# EasyEDA Pro project ProPrj_Avaota A1 八核 AIoT 开发板_2024-05-03.epro, schematic Avaota Pi A, sheets 6 to 13 of 13 (continued)
## Sheets (continued)
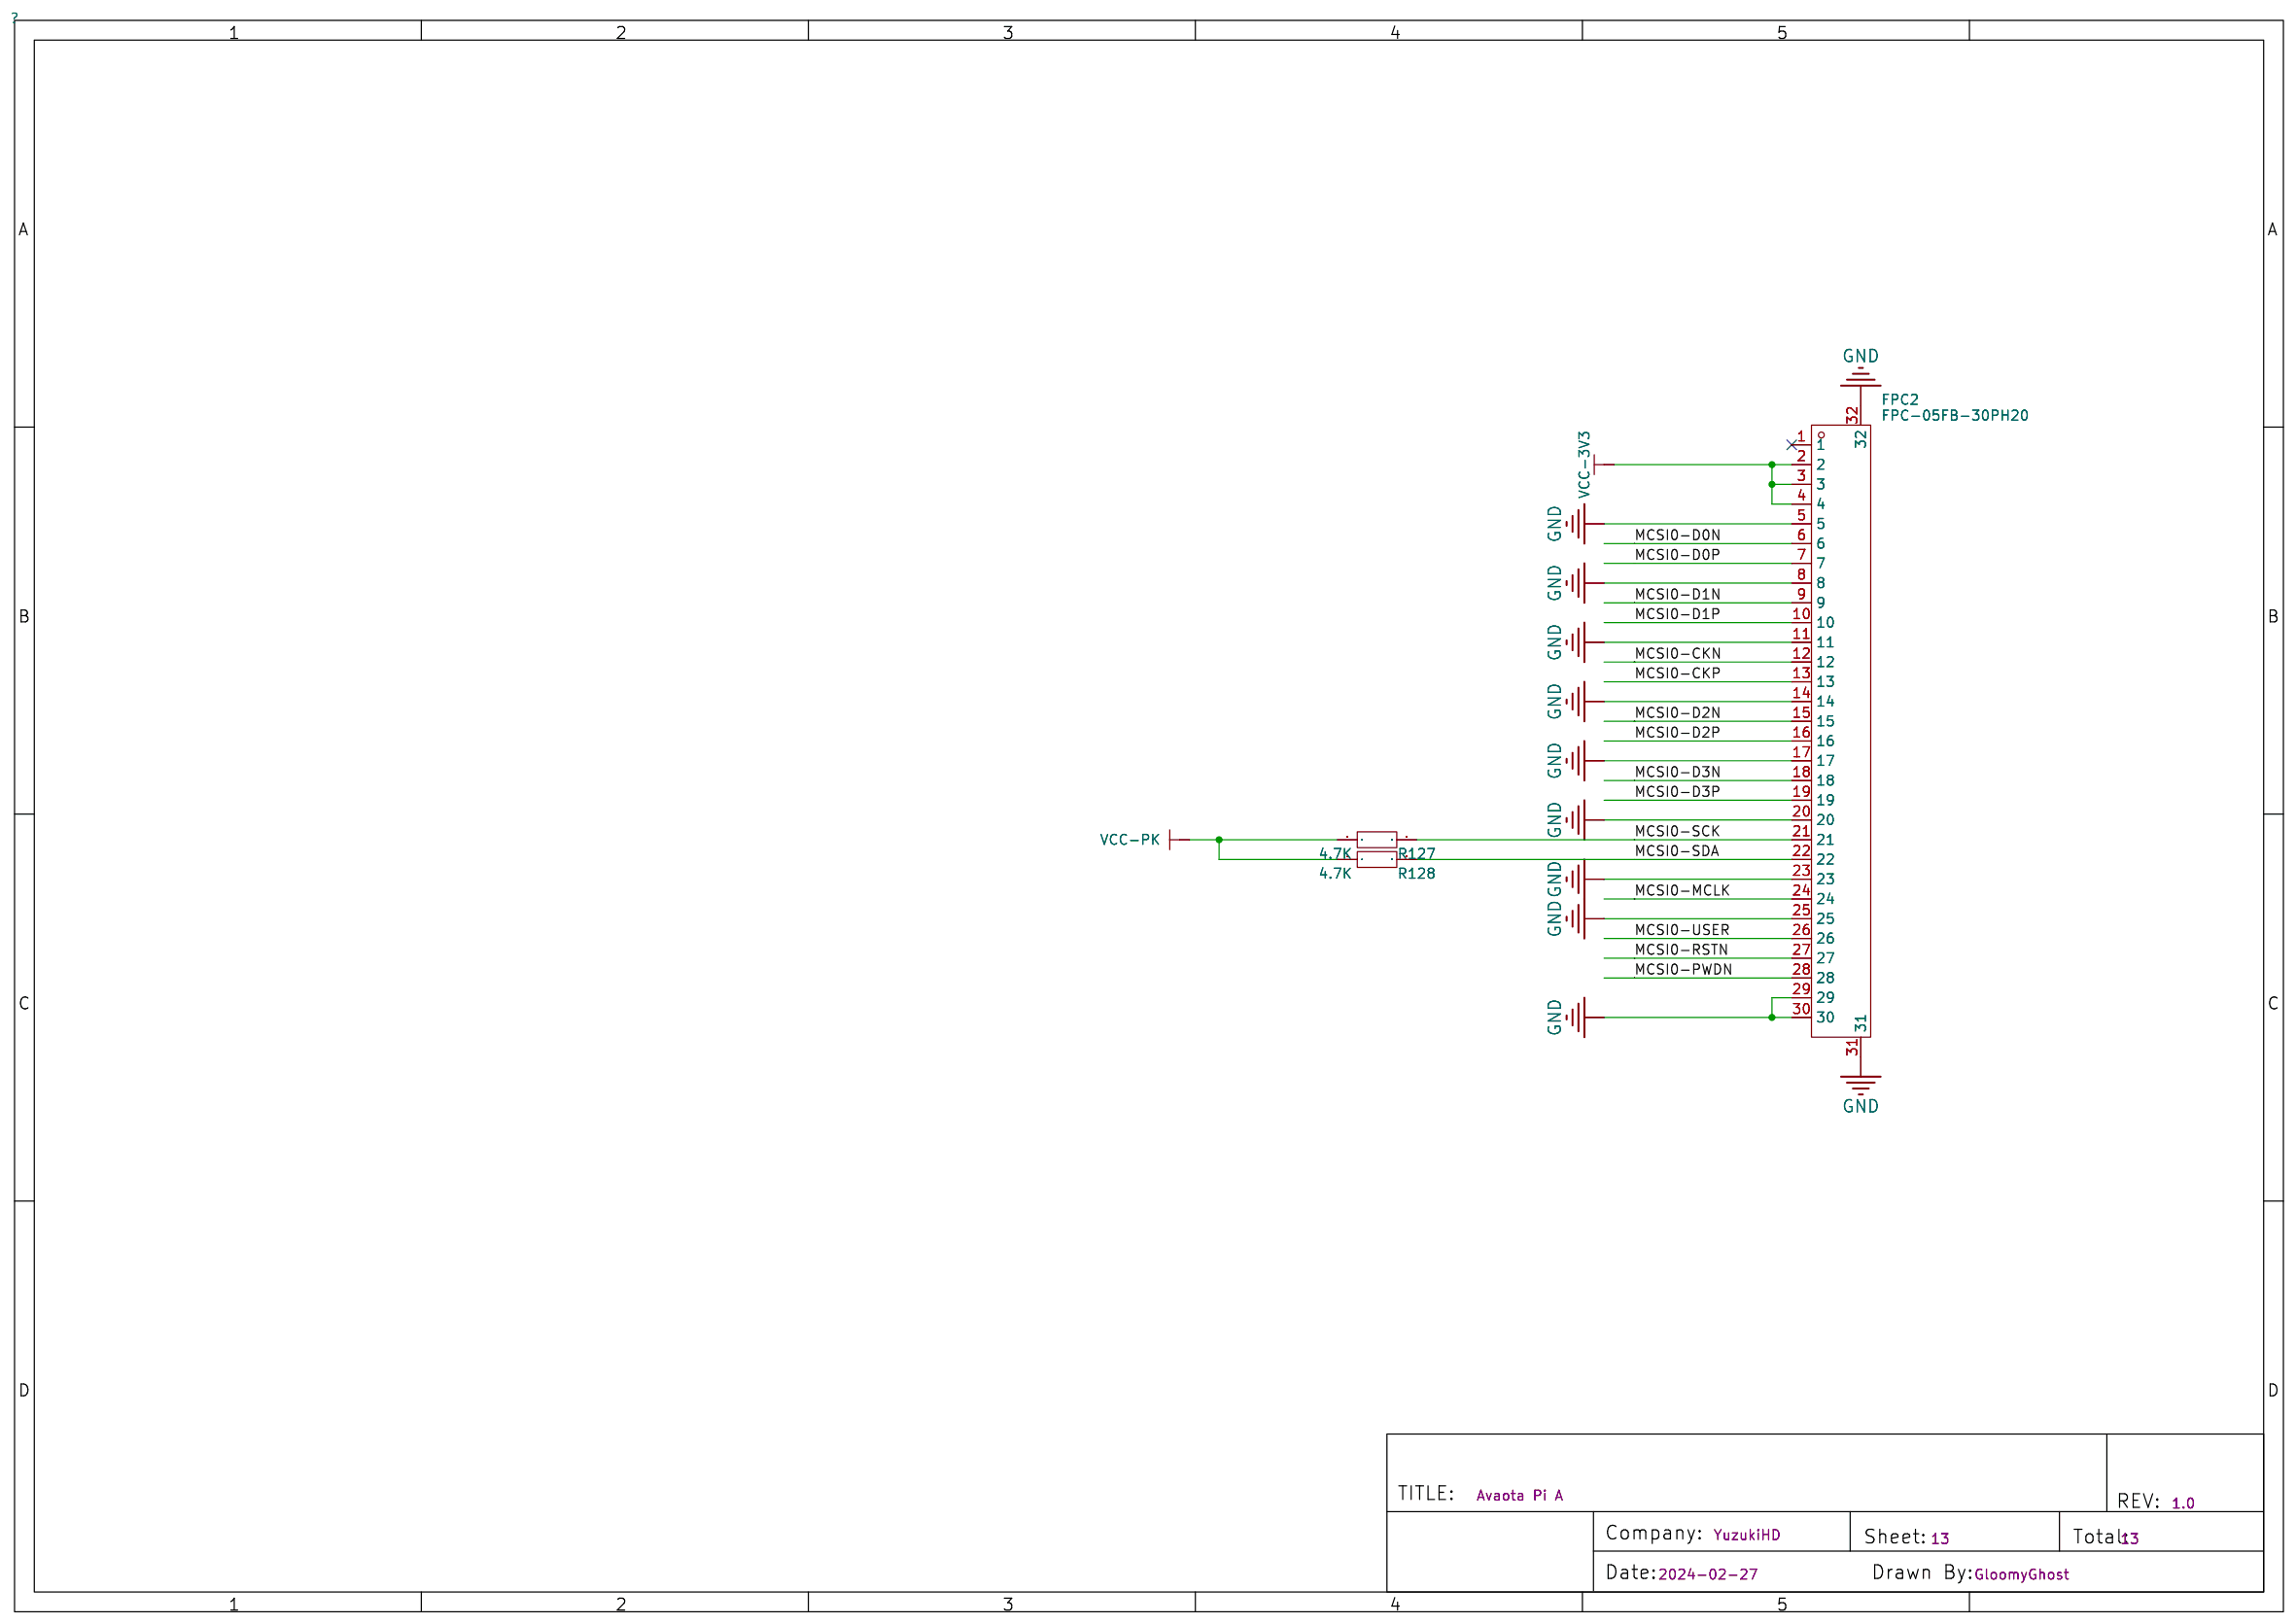
[diagram p12: CAMERA]

## Parts
sheet 12VDC
C1  100nF  [C0603-NSK]
C2  100nF  [C0603-NSK]
C3  100nF  [C0603-NSK]
C4  100nF  [c0402-nsk]
C5  47uF  [C0805 NSK]
C6  47uF  [C0805 NSK]
C7  100nF  [C0603-NSK]
C8  100nF  [C0603-NSK]
C9  2200pF  [c0402-nsk]
C10  22pF  [c0402-nsk]
CN4  0533980271  [CONN-SMD_2P-P1.25_053398-0X71]
D1  B5819WS  [SOD-323_L1.8-W1.3-LS2.5-RD]
D2  SMCJ15CA  [SMC_L6.9-W5.9-LS7.9-BI]
D3  SS54  [SMA_L4.4-W2.8-LS5.4-R-RD]
D4  SS54  [SMA_L4.4-W2.8-LS5.4-R-RD]
DC1  DC-044A-A200  [DC-IN-TH_DC-044A-20A]
L1  4.7uH  [IND-SMD_L7.0-W6.6]
Q1  YJL2305A  [SOT-23-3_L2.9-W1.3-P1.90-LS2.4-BR]
R1  100K  [R0603 NSK]
R2  100K  [R0603 NSK]
R3  51.1  [R0402-NSK]
R4  665K  [R0402-NSK]
R5  10.2K  [R0402-NSK]
R6  130K  [R0402-NSK]
R7  37.4K  [R0402-NSK]
R8  1.96K  [R0402-NSK]
U1  100uF  [CAP-SMD_BD6.3-L6.6-W6.6-LS7.6-RD]
U2  100uF  [CAP-SMD_BD6.3-L6.6-W6.6-LS7.6-RD]
U3  TPS54531DDAR  [SOIC-8_L5.0-W4.0-P1.27-LS6.0-BL-EP2.0]
sheet CAMERA
FPC2  FPC-05FB-30PH20  [FPC-SMD_30P-P0.50_FPC-05FB-30PH20]
R127  4.7K  [r0201 nsk]
R128  4.7K  [r0201 nsk]
sheet GMAC0
C248  10nF/2KV  [C1206]
C249  2.2uF  [c0201 nsk]
C250  2.2uF  [c0201 nsk]
C251  22pF  [c0201 nsk]
C252  22pF  [c0201 nsk]
C253  2.2uF  [c0201 nsk]
C254  100nF  [c0201 nsk]
C262  100nF  [c0201 nsk]
C263  100nF  [c0201 nsk]
C264  100nF  [c0201 nsk]
C265  100nF  [c0201 nsk]
C266  100nF  [c0201 nsk]
C267  100nF  [c0201 nsk]
C268  100nF  [c0201 nsk]
L9  2.2uH  [IND-SMD_L2.0-W1.6]
R79  510  [r0201 nsk]
R80  510  [r0201 nsk]
R82  4.7K  [r0201 nsk]
R83  1.5K  [r0201 nsk]
R85  2.49K  [r0201 nsk]
R86  4.7K  [r0201 nsk]
R88  4.7K  [r0201 nsk]
R89  4.7K  [r0201 nsk]
R90  4.7K  [r0201 nsk]
R91  4.7K  [r0201 nsk]
R92  4.7K  [r0201 nsk]
R93  4.7K  [r0201 nsk]
R94  4.7K  [r0201 nsk]
R95  4.7K  [r0201 nsk]
R96  4.7K  [r0201 nsk]
RJ1  -  [RJ45-TH_HR911130A]
U12  RTL8211F-CG  [WQFN-40_L5.0-W5.0-P0.4-BL-EP]
X3  25MHz  [crystal-smd_4p-l2.0-w1.6-bl-nsk]
sheet GMAC1
C255  10nF/2KV  [C1206]
C256  2.2uF  [c0201 nsk]
C257  22pF  [c0201 nsk]
C258  2.2uF  [c0201 nsk]
C259  22pF  [c0201 nsk]
C260  2.2uF  [c0201 nsk]
C261  100nF  [c0201 nsk]
C269  100nF  [c0201 nsk]
C270  100nF  [c0201 nsk]
C271  100nF  [c0201 nsk]
C272  100nF  [c0201 nsk]
C273  100nF  [c0201 nsk]
C274  100nF  [c0201 nsk]
C275  100nF  [c0201 nsk]
L10  2.2uH  [IND-SMD_L2.0-W1.6]
R97  510  [r0201 nsk]
R98  510  [r0201 nsk]
R100  4.7K  [r0201 nsk]
R101  1.5K  [r0201 nsk]
R103  2.49K  [r0201 nsk]
R104  4.7K  [r0201 nsk]
R106  4.7K  [r0201 nsk]
R107  4.7K  [r0201 nsk]
R108  4.7K  [r0201 nsk]
R109  4.7K  [r0201 nsk]
R110  4.7K  [r0201 nsk]
R111  4.7K  [r0201 nsk]
R112  4.7K  [r0201 nsk]
R113  4.7K  [r0201 nsk]
R114  4.7K  [r0201 nsk]
RJ2  -  [RJ45-TH_HR911130A]
U13  RTL8211F-CG  [WQFN-40_L5.0-W5.0-P0.4-BL-EP]
X4  25MHz  [crystal-smd_4p-l2.0-w1.6-bl-nsk]
sheet PERF1
C189  100nF  [c0201 nsk]
C190  100nF  [c0201 nsk]
C191  100nF  [c0201 nsk]
C192  100nF  [c0201 nsk]
C193  100nF  [c0201 nsk]
C194  100nF  [c0201 nsk]
C195  100nF  [c0201 nsk]
C196  100nF  [c0201 nsk]
C197  100nF  [c0201 nsk]
C198  100nF  [c0201 nsk]
C199  100nF  [c0201 nsk]
C200  10uF  [c0402-nsk]
C201  2.2uF  [c0201 nsk]
C202  2.2uF  [c0201 nsk]
C204  2.2uF  [c0201 nsk]
C208  2.2uF  [c0201 nsk]
C209  100nF  [c0201 nsk]
C210  2.2uF  [c0201 nsk]
C211  100nF  [c0201 nsk]
C213  100nF  [c0201 nsk]
C214  2.2uF  [c0201 nsk]
C215  2.2uF  [c0201 nsk]
C216  100nF  [c0201 nsk]
C218  100nF  [c0201 nsk]
C219  100nF  [c0201 nsk]
C220  100nF  [c0201 nsk]
C221  2.2uF  [c0402-nsk]
C222  100nF  [c0402-nsk]
C223  2.2uF  [c0402-nsk]
C224  100nF  [c0402-nsk]
C280  100nF  [c0402-nsk]
C281  22uF  [C0603-NSK]
C282  22uF  [C0603-NSK]
C294  22uF  [C1206]
D5  RClamp0524PATCT  [SLP2510P8_L2.5-W1.0-P0.50-BL]
D6  RClamp0524PATCT  [SLP2510P8_L2.5-W1.0-P0.50-BL]
D7  B5819WT  [SOD-523_L1.2-W0.8-LS1.6-RD-1 NSK]
D8  RClamp0524PATCT  [SLP2510P8_L2.5-W1.0-P0.50-BL]
D9  B5819WT  [SOD-523_L1.2-W0.8-LS1.6-RD-1 NSK]
D10  RClamp0524PATCT  [SLP2510P8_L2.5-W1.0-P0.50-BL]
D11  RClamp0524PATCT  [SLP2510P8_L2.5-W1.0-P0.50-BL]
D12  RClamp0524PATCT  [SLP2510P8_L2.5-W1.0-P0.50-BL]
D13  RClamp0524PATCT  [SLP2510P8_L2.5-W1.0-P0.50-BL]
D14  RClamp0524PATCT  [SLP2510P8_L2.5-W1.0-P0.50-BL]
D15  RClamp0524PATCT  [SLP2510P8_L2.5-W1.0-P0.50-BL]
D24  0402ESDA-05N  [d0402]
D25  0402ESDA-05N  [d0402]
D26  0402ESDA-05N  [d0402]
D27  0402ESDA-05N  [d0402]
D30  0402ESDA-05N  [d0402]
D31  0402ESDA-05N  [d0402]
R44  200  [r0201 nsk]
R45  200  [r0201 nsk]
R46  200  [r0201 nsk]
R47  10K  [r0201 nsk]
R48  100  [r0201 nsk]
R49  1K  [r0201 nsk]
R50  100  [r0201 nsk]
R51  100  [r0201 nsk]
R52  4K7  [r0201 nsk]
R53  4K7  [r0201 nsk]
R54  1K  [r0201 nsk]
R55  1K  [r0201 nsk]
R56  1M  [r0201 nsk]
R57  1M  [r0201 nsk]
R59  1K  [r0201 nsk]
R60  10K  [r0201 nsk]
R61  100K  [r0201 nsk]
R62  100K  [r0201 nsk]
R117  6K8  [r0201 nsk]
R118  100K  [r0201 nsk]
R120  180K  [r0201 nsk]
R121  100K  [r0201 nsk]
R129  5.1K  [r0201 nsk]
R130  5.1K  [r0201 nsk]
U15  -  [DP_TH_SIDE_VERTICAL]
U17  SY6280AAC  [SOT-23-5_L3.0-W1.7-P0.95-LS2.8-BL]
USB1  HDMI-001C  [HDMI-SMD_HDMI-001C]
USB2  USB-303WSD-BRY  [USB-A-TH_XUNPU_USB-303WSD-BRY]
USB3  -  [USB-C-SMD_TYPEC-304-BCP16-1]
sheet PERF2
C225  2.2uF  [c0201 nsk]
C226  100nF  [c0201 nsk]
C227  100nF  [c0201 nsk]
C228  2.2uF  [c0201 nsk]
C229  100nF  [c0201 nsk]
C230  100nF  [c0201 nsk]
C231  2.2uF  [c0201 nsk]
C232  100nF  [c0201 nsk]
C233  100nF  [c0201 nsk]
C234  2.2uF  [c0201 nsk]
C235  100nF  [c0201 nsk]
C236  100nF  [c0201 nsk]
C276  2.2uF  [c0201 nsk]
C277  2.2uF  [c0201 nsk]
D16  0402ESDA-05N  [D0402]
D17  0402ESDA-05N  [D0402]
D18  0402ESDA-05N  [D0402]
D19  0402ESDA-05N  [D0402]
D20  0402ESDA-05N  [D0402]
D21  0402ESDA-05N  [D0402]
D22  0402ESDA-05N  [D0402]
D23  0402ESDA-05N  [D0402]
FPC1  FPC-05FB-50PH20  [FPC-SMD_50P-P0.50_FPC-05FB-50PH20]
H1  12251220ANG0S115001  [HDR-TH_40P-P2.54-V-M-R2-C20-S2.54]
LED2  WS2812B-2020  [LED-SMD_4P-L2.0-W2.0-TL_WS2812B-2020]
LED3  WS2812B-2020  [LED-SMD_4P-L2.0-W2.0-TL_WS2812B-2020]
LED4  WS2812B-2020  [LED-SMD_4P-L2.0-W2.0-TL_WS2812B-2020]
LED5  WS2812B-2020  [LED-SMD_4P-L2.0-W2.0-TL_WS2812B-2020]
R63  10K  [r0201 nsk]
R115  6K8  [r0201 nsk]
R116  6K8  [r0201 nsk]
R119  100K  [r0201 nsk]
R126  1K  [R0402-NSK]
SIM1  1040310811  [SIM-SMD_8P-1040310811]
TFT1  -  [TFT_1.14寸_0.7MM-13P]
U8  -  [FBGA-153_L13.0-W11.5]
U16  SY6280AAC  [SOT-23-5_L3.0-W1.7-P0.95-LS2.8-BL]
sheet PERF3
C237  2.2uF  [c0402-nsk]
C238  100nF  [c0201 nsk]
C239  33pF  [c0201 nsk]
C240  100nF  [c0201 nsk]
C241  100nF  [c0201 nsk]
C242  100nF  [c0402-nsk]
C243  100nF  [c0402-nsk]
C244  NC  [c0201 nsk]
C245  NC  [c0201 nsk]
C246  100nF  [c0402-nsk]
C247  2.2uF  [c0402-nsk]
CGQ1  IRM-H638T/TR2  [SENSOR-SMD_IRM-H638T-TR2-TL]
CN2  PJ-327A0-SMT  [AUDIO-SMD_PJ-327A0-SMT]
CN3  0533980271  [CONN-SMD_2P-P1.25_053398-0X71]
R64  2K  [r0201 nsk]
R65  10K  [r0201 nsk]
R66  10K  [r0201 nsk]
R67  22  [r0201 nsk]
R68  22  [r0201 nsk]
R69  10K  [r0201 nsk]
R70  10K  [r0201 nsk]
R72  0  [r0201 nsk]
R73  10K  [r0201 nsk]
R74  10K  [r0201 nsk]
R75  10K  [r0201 nsk]
R76  10K  [r0201 nsk]
R77  60  [r0201 nsk]
R78  60  [r0201 nsk]
R122  0  [r0201 nsk]
R124  10k  [r0201 nsk]
R125  33  [r0201 nsk]
RF1  BWIPX-1-001E  [IPEX-SMD_BWIPX-1-001E]
U9  AIC8800D  [LGA-44_L12.0-W12.0-P0.90]
U11  TJA1051T  [SOP-8_L4.9-W3.9-P1.27-LS6.0-BL]
U18  W25N01GVZEIG  [WSON-8_L8.0-W6.10-P1.27-BL-EP]
sheet POWER
U14  T527  [T527-BGA664]  (sections Audio_ADC,DRAM,GND,IO_1,IO_2,PERF,SoC,VCC)

## Library data of the parts
C1-C3 C7 C8 C281 C282 = CAP_0603: Supplier Footprint: 0603
C4 C9 C10 C200 C221-C224 C237 C242 C243 C246 C247 C280 = CAP_0402: Supplier Footprint: 0402
C5 C6 = CAP_0805: Supplier Footprint: 0805
CN3 CN4 = 0533980271: 插针结构:1x2P;间距:1.25mm;安装方式:立贴;参考系列:-;总PIN数:2P;排数:1;每排PIN数:2;行距:-;额定电流:-;触头材质:磷青铜;触头镀层:锡;工作温度范围:-;; LCSC Part Name: 1x2P 间距:1.25mm 立贴; Supplier Part: C122410; Manufacturer: MOLEX; Supplier Footprint: SMD,P=1.25mm; JLCPCB Part Class: 扩展库; Datasheet: https://atta.szlcsc.com/upload/public/pdf/source/20170721/C122410_1500619309943834053.pdf; Supplier: LCSC; Pins Structure: 1x2P; Pitch: 1.25mm; Mounting Style: 立贴; Number of Pins: 2P; Number of Rows: 1; Number of PINs Per Row: 2; Contact Material: 磷青铜; Contact Plating: 锡
D1 = B5819WS_C22624: 正向压降(Vf):600mV@1A;直流反向耐压(Vr):40V;平均整流电流(Io):1A;; LCSC Part Name: 电压:40V 电流:1A; Supplier Part: C22624; Manufacturer: CJ(江苏长电/长晶); Supplier Footprint: SOD-323; JLCPCB Part Class: 扩展库; Datasheet: https://atta.szlcsc.com/upload/public/pdf/source/20150407/1457707273359.pdf; Supplier: LCSC; Forward Voltage (Vf@If): 600mV@1A; Reverse Voltage (Vr): 40V; Average Rectified Current (Io): 1A
D2 = SMCJ15CA_C438202: Supplier Part: C438202; Manufacturer: 晶导微电子; Supplier Footprint: SMC; JLCPCB Part Class: 扩展库; Datasheet: https://atta.szlcsc.com/upload/public/pdf/source/20191016/C438242_A63B17745ADA505032D55B9AC6D6140F.pdf; Supplier: LCSC
D3 D4 = SS54_C22452: 正向压降(Vf):550mV@5A;直流反向耐压(Vr):40V;平均整流电流(Io):5A;; LCSC Part Name: 电压:40V 电流:5A; Supplier Part: C22452; Manufacturer: MDD; Supplier Footprint: SMA(DO-214AC); JLCPCB Part Class: 基础库; Datasheet: https://atta.szlcsc.com/upload/public/pdf/source/20230314/529CD85F9B31F69841D3A079BC07E377.pdf; Supplier: LCSC; Forward Voltage (Vf@If): 550mV@5A; Reverse Voltage (Vr): 40V; Average Rectified Current (Io): 5A; Reverse Leakage Current (Ir): 1mA@40V
DC1 = DC-044A-A200: 连接器类型:DC电源插座;安装方式:弯插;触点内径:2mm;触点外径:5.9mm;额定电流:3A;额定电压:30V;工作温度范围:-20℃~+70℃;; LCSC Part Name: DC电源插座 内径:2mm 外径:5.9mm; Supplier Part: C720575; Manufacturer: XUNPU(讯普); Supplier Footprint: 插件; JLCPCB Part Class: 扩展库; Datasheet: https://atta.szlcsc.com/upload/public/pdf/source/20200812/C720575_4790492998F066C820F633EA8FAFF763.pdf; Supplier: LCSC; Connector Type: DC电源插座; Mounting Style: 弯插; Inside Contact Diameter: 2mm; Outside Contact Diameter: 5.9mm; Current Rating (Max): 3A; Voltage Rating (Max): 30V; Operating Temperature Range: -20℃~+70℃
L1 = FXL0630-4R7-M: 电感值:4.7uH;精度:±20%;额定电流:6A;饱和电流(Isat):9A;类型:一体成型电感;; LCSC Part Name: 4.7uH ±20% 9A; Supplier Part: C167220; Manufacturer: cjiang(长江微电); Supplier Footprint: SMD,6.6x7mm; JLCPCB Part Class: 扩展库; Datasheet: https://atta.szlcsc.com/upload/public/pdf/source/20230516/3A080F5AF8C87BB81C3BA86E5F60E51A.pdf; Supplier: LCSC; Tolerance: ±20%; Rated Current: 6A; Saturation Current (Isat): 9A; DC Resistance (DCR): 33mΩ; Type: 一体成型电感
Q1 = YJL2305A: 类型:P沟道;漏源电压(Vdss):15V;连续漏极电流(Id):5.6A;功率(Pd):1.2W;导通电阻(RDS(on)@Vgs,Id):25mΩ@4.5V,5.6A;阈值电压(Vgs(th)@Id):1V@250uA;; LCSC Part Name: P沟道 耐压:15V 电流:5.6A; Supplier Part: C699306; Manufacturer: YANGJIE(扬杰); Supplier Footprint: SOT-23(TO-236); JLCPCB Part Class: 扩展库; Datasheet: https://atta.szlcsc.com/upload/public/pdf/source/20200709/C699306_A321381AA1EB3D502A51672BD4542002.pdf; Supplier: LCSC; Type: P沟道; Drain Source Voltage (Vdss): 15V; Continuous Drain Current (Id): 5.6A; Power Dissipation (Pd): 1.2W; Drain Source On Resistance (RDS(on)@Vgs,Id): 25mΩ@4.5V,5.6A; Gate Threshold Voltage (Vgs(th)@Id): 1V@250uA; Total Gate Charge (Qg@Vgs): 7.2nC@4.5V; Input Capacitance (Ciss@Vds): 890pF@9V; Reverse Transfer Capacitance (Crss@Vds): 85pF@9V; Operating Temperature: -55℃~+150℃@(Tj)
R1 R2 = Res_0603: Supplier Footprint: 0603
R3-R8 R126 = Res_0402: Supplier Footprint: 0402
U1 U2 = RVT1H101M0607: 容值:100uF;精度:±20%;额定电压:50V;纹波电流:229mA@120Hz;; LCSC Part Name: 100uF ±20% 50V; Supplier Part: C3151829; Manufacturer: ROQANG(容强); Supplier Footprint: SMD,D6.3xL7.7mm; JLCPCB Part Class: 扩展库; Datasheet: https://atta.szlcsc.com/upload/public/pdf/source/20170325/1490427950282.pdf; Supplier: LCSC; Tolerance: ±20%; Rated Voltage: 50V; Ripple Current: 229mA@120Hz; φD: 6.3mm; L: 7.7mm; Lifetime @ Temp: 2000hrs@105℃; Operating Temperature: -40℃~+105℃
U3 = TPS54531DDAR: 功能类型:降压型;输出类型:可调;输入电压:3.5V~28V;输出电压:800mV~26.04V;输出电流(最大值):5A;; Supplier Part: C50605; Manufacturer: TI(德州仪器); Supplier Footprint: SOIC-8-EP; JLCPCB Part Class: 扩展库; Datasheet: https://www.ti.com/cn/lit/gpn/tps54531; Supplier: LCSC; Function: 降压型; Output Type: 可调; Input Voltage: 3.5V~28V; Output Voltage: 800mV~26.04V; Output Current (Max): 5A; Switching Frequency: 570kHz; Operating Temperature: -40℃~+85℃@(TA); Synchronous Rectification: 否; Number of Outputs: 1; Topology: 降压式; Switch tube (built-in/external): 内置
FPC2 = FPC-05FB-30PH20: 锁定特性:翻盖式;触点类型:双侧触点/上下接;触点数量:30P;间距:0.5mm;安装类型:卧贴;工作温度范围:-25℃~+85℃;; LCSC Part Name: 间距:0.5mm P数:30P 翻盖式 双侧触点/上下接; Supplier Part: C2856833; Manufacturer: XUNPU(讯普); Supplier Footprint: SMD,P=0.5mm,卧贴; JLCPCB Part Class: 扩展库; Datasheet: https://atta.szlcsc.com/upload/public/pdf/source/20210922/C2856833_974F2E309F01E02BEE862D1FB45F93FA.pdf; Supplier: LCSC; Locking Feature: 翻盖式; Contact Type: 双侧触点/上下接; Number of Contacts: 30P; Pitch: 0.5mm; Mounting Type: 卧贴; FFC, FCB Thickness: 0.3mm; Height Above Board: 2mm; Operating Temperature Range: -25℃~+85℃
R44-R57 R59-R70 R72-R80 R82 R83 R85 R86 R88-R98 R100 R101 R103 R104 R106-R122 R124 R125 R127-R130 = Res_0201: Supplier Footprint: 0201
C248 C255 C294 = CAP_1206: Supplier Footprint: 1206
C225 C228 C231 C234 C249 C250 C253 C254 C256 C258 C260-C277 = 0201X225M6R3NT: 容值:2.2uF;精度:±20%;额定电压:6.3V;材质(温度系数):X5R;; LCSC Part Name: 2.2uF ±20% 6.3V; Supplier Part: C285111; Manufacturer: FH(风华); Supplier Footprint: 0201; JLCPCB Part Class: 扩展库; Datasheet: https://atta.szlcsc.com/upload/public/pdf/source/20180913/C285111_405173511BA094D64E8CAA96F7E40A73.pdf; Supplier: LCSC; Tolerance: ±20%; Voltage Rated: 6.3V; Temperature Coefficient: X5R
C251 C252 C257 C259 = 0201CG220J500NT: 容值:22pF;精度:±5%;额定电压:50V;材质(温度系数):C0G;; LCSC Part Name: 22pF ±5% 50V; Supplier Part: C57783; Manufacturer: FH(风华); Supplier Footprint: 0201; JLCPCB Part Class: 扩展库; Datasheet: https://atta.szlcsc.com/upload/public/pdf/source/20200305/C486355_26A10D38EF8C2A5C37091D0039909270.pdf; Supplier: LCSC; Tolerance: ±5%; Voltage Rated: 50V; Temperature Coefficient: C0G
L9 L10 = WPN252012H2R2MT: 电感值:2.2uH;精度:±20%;额定电流:1.9A;饱和电流(Isat):3A;类型:-;; LCSC Part Name: 2.2uH ±20% 3A; Supplier Part: C98350; Manufacturer: Sunlord(顺络); Supplier Footprint: 1008; JLCPCB Part Class: 扩展库; Datasheet: https://atta.szlcsc.com/upload/public/pdf/source/20231024/AA72387348CB63159A6CBE41DDE5ECDA.pdf; Supplier: LCSC; Tolerance: ±20%; Rated Current: 1.9A; Saturation Current (Isat): 3A; DC Resistance (DCR): 120mΩ
RJ1 RJ2 = HR911130A: 连接器类型:RJ插座;USOC代码:RJ45;端口数量:1;等级:-;屏蔽:-;LED:有;; LCSC Part Name: RJ45; Supplier Part: C54408; Manufacturer: HANRUN(汉仁); Supplier Footprint: 插件; JLCPCB Part Class: 扩展库; Datasheet: https://atta.szlcsc.com/upload/public/pdf/source/20151014/1457707458393.pdf; Supplier: LCSC; Connector Type: RJ插座; USOC Codes: RJ45; Number of Ports: 1; LED: 有
U12 U13 = RTL8211F-CG: 应用功能:-;通道数:-;接口类型:-;; Supplier: LCSC; Supplier Part: C187932; Manufacturer: REALTEK(瑞昱); JLCPCB Part Class: 扩展库; LCSC Part Name: 集成10/100/1000M以太网精密收发器; Supplier Footprint: WQFN-40-EP(5x5); Datasheet: https://atta.szlcsc.com/upload/public/pdf/source/20190902/C187932_1913F3711F05FE1324DF2946D70D648D.pdf
X3 X4 = 7D025000Q01: 晶振类型:贴片晶振;频率:25MHz;常温频差:±10ppm;外接负载电容:18pF;频率稳定度(全温):±20ppm;; LCSC Part Name: 25MHz ±10ppm 18pF; Supplier Part: C648942; Manufacturer: HD(浩都频率); Supplier Footprint: SMD2016-4P; JLCPCB Part Class: Extended Part; Datasheet: https://atta.szlcsc.com/upload/public/pdf/source/20220223/891C6A51CC6F69B73E92651637DFAA51.pdf; Supplier: LCSC; Crystal Type: 贴片晶振; Normal temperature Frequency Tolerance: ±10ppm; External load capacitor: 18pF; Frequency Stability(Full temperature range): ±20ppm
C189-C199 C201 C202 C204 C208-C211 C213-C216 C218-C220 C226 C227 C229 C230 C232 C233 C235 C236 C238-C241 C244 C245 = GRM033R61A104KE15D: 容值:100nF;精度:±10%;额定电压:10V;材质(温度系数):X5R;; LCSC Part Name: 100nF ±10% 10V; Supplier Part: C76934; Manufacturer: muRata(村田); Supplier Footprint: 0201; JLCPCB Part Class: Extended Part; Datasheet: https://atta.szlcsc.com/upload/public/pdf/source/20180307/C76934_15204090982891407723.pdf; Supplier: LCSC; Tolerance: ±10%; Voltage Rated: 10V; Temperature Coefficient: X5R
D5 D6 D8 D10-D15 = RClamp0524PATCT_C40960: 反向截止电压(Vrwm):5V;最大钳位电压:15V;峰值脉冲功率(Ppp)@10/1000us:150W;击穿电压:6V;; Supplier Part: C40960; Manufacturer: SEMTECH; Supplier Footprint: SLP2510-8; JLCPCB Part Class: 扩展库; Datasheet: https://atta.szlcsc.com/upload/public/pdf/source/20150124/1457707260739.pdf; Supplier: LCSC; Reverse Stand-Off Voltage (Vrwm): 5V; Maximum Clamping Voltage: 15V; Peak Pulse Power Dissipation (Ppp)@10/1000us: 150W; Breakdown Voltage: 6V; Number of Lines: 四路; Operating Temperature: -55℃~+125℃@(Tj); Type: ESD
D7 D9 = B5819WT_C2997265: 二极管配置:-;正向压降(Vf):600mV@200mA;直流反向耐压(Vr):40V;平均整流电流(Io):1A;; LCSC Part Name: 电压:40V 电流:1A; Supplier Part: C2997265; Manufacturer: BORN(伯恩半导体); Supplier Footprint: SOD-523; JLCPCB Part Class: 扩展库; Datasheet: https://atta.szlcsc.com/upload/public/pdf/source/20220826/529B3A9034D5C6632B715AD177467069.pdf; Supplier: LCSC; Forward Voltage (Vf@If): 600mV@200mA; Reverse Voltage (Vr): 40V; Average Rectified Current (Io): 1A; Reverse Leakage Current (Ir): 5uA@30V
D24-D27 D30 D31 = 0402ESDA-05N: 极性:Bidirectional;反向关断电压（典型值）:5V;击穿电压（最小值）:-;箝位电压:50V;峰值脉冲电流（10/1000us）:-;; Supplier Part: C316049; Manufacturer: BORN伯恩半导体; Supplier Footprint: 0402; JLCPCB Part Class: Extended Part; Datasheet: https://atta.szlcsc.com/upload/public/pdf/source/20181026/C316049_37ABAC87650F175221BFB473159300DE.pdf; Supplier: LCSC; Polarity: Bidirectional; Reverse Stand-Off Voltage (Vrwm): 5V; Clamping Voltage@Ipp: 50V; Voltage - Reverse Standoff (Typ): 5V; Voltage - Clamping (Max) @ Ipp: 50V
U15 = DP_TH_SIDE_VERTICAL
U16 U17 = SY6280AAC_C55136: 低能耗配电开关; Supplier Part: C55136; Manufacturer: silergy(矽力杰); Supplier Footprint: SOT-23-5; JLCPCB Part Class: 扩展库; Datasheet: https://atta.szlcsc.com/upload/public/pdf/source/20161108/1478586372822.pdf; Supplier: LCSC
USB1 = HDMI-001C_C2836126: 连接器类型:HDMI;公母:母;总PIN位数:19P;安装方式:弯插;排数:2;额定电流:500mA;触头材质:-;触头镀层:-;工作温度范围:-45℃~+85℃;; LCSC Part Name: HDMI 母 P数:19P; Supplier Part: C2836126; Manufacturer: XUNPU(讯普); Supplier Footprint: 弯插; JLCPCB Part Class: 扩展库; Datasheet: https://atta.szlcsc.com/upload/public/pdf/source/20200810/C720617_FFAEEC9A8F7AC9847E6A422865303F15.pdf; Supplier: LCSC; Connector Type: HDMI; Gender: 母; Number of Pins: 19P; Mounting Style: 弯插; Number of Rows: 2; Current Rating (Max): 500mA; Operating Temperature Range: -45℃~+85℃